# Altium schematic sheet csi-camera-ethernet.SchDoc: HDMI / CAMERA / DISPLAY / SDCARD
size A4; ApprovedBy: Yves Chevallier; CheckedBy: Yves Chevallier; Author: Yves Chevallier; CompanyName: EPFL; DrawnBy: Yves Chevallier; Engineer: Yves Chevallier; Organization: EPFL; Address1: EPFL; Address2: CH1015 Lausanne; Address3: +41(0)21 693 36 98; Address4: +41(0)21 693 26 00; DocumentNumber: ABC.00.0000.000.0; Revision: v1.0; SheetNumber: 0; SheetTotal: 0; DrawnByDate: 2000-01-01; ExecutionWarrantDate: 2000-01-01; ExecutionWarrant: Yves Chevallier; Context: Confidential; PageSetup: Record=PageOptions|CenterHorizontal=True|CenterVertical=False|PrintScale=0.97|XCorrection=1.00|YCorrection=1.00|PrintKind=0|BorderSize=5000000|LeftOffset=0|BottomOffset=0|Orientation=2|PaperLength=1000|PaperWidth=1000|Scale=100|PaperSource=262|PrintQuality=600|MediaType=1|DitherType=10|PaperKind=A4|PrintScaleMode=1; EngineerDate: 2000-01-01; CheckedByDate: 2000-01-01; SVN: OUI; ProjectName: PRJ
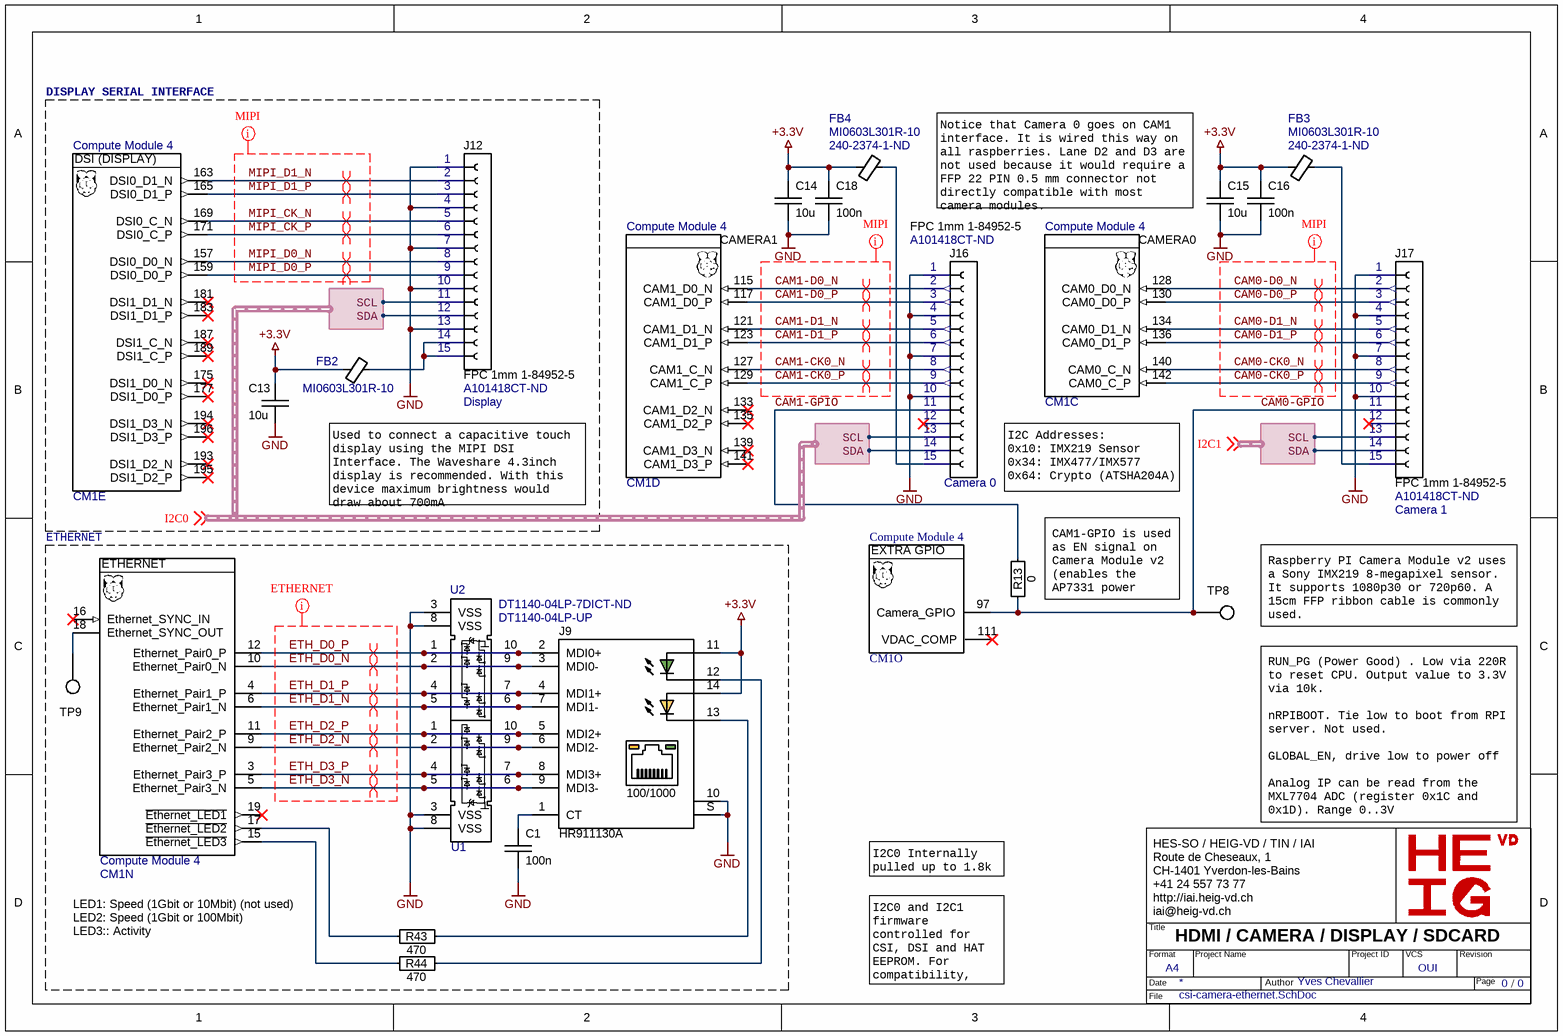
[diagram p0: csi-camera-ethernet.SchDoc]

## Parts
(Parts that share a designator on the sheet are numbered #1, #2 ... from top to bottom, then left to right.)
C1  100n  [SM/C0603]
C13  10u  [SM/C0805]
C14  10u  [SM/C0805]
C15  10u  [SM/C0805]
C16  100n  [SM/C0603]
C18  100n  [SM/C0603]
CM1#1  Compute Module 4  [CM4-RASPBERRY-PI4]  (parts C,D,E,N of 16)
CM1#2  Compute Module 4  [CM4-RASPBERRY-PI4]  (part O of 15)
FB2  MI0603L301R-10  [SM/L0603]
FB3  MI0603L301R-10  Supplier Part Number 1: 240-2374-1-ND  [SM/L0603]
FB4  MI0603L301R-10  Supplier Part Number 1: 240-2374-1-ND  [SM/L0603]
J9  HR911130A  [CONN/ETHERNET/HR911130A]
J12  FPC 1mm 1-84952-5  Supplier Part Number 1: A101418CT-ND  Function: Display  [CONN15/FPC/TE/1-84952-5]
J16  FPC 1mm 1-84952-5  Supplier Part Number 1: A101418CT-ND  Function: Camera 0  [CONN15/FPC/TE/1-84952-5]
J17  FPC 1mm 1-84952-5  Supplier Part Number 1: A101418CT-ND  Function: Camera 1  [CONN15/FPC/TE/1-84952-5]
R13  0  [SM/R0805]
R43  470  [SM/R0603]
R44  470  [SM/R0603]
TP8  TP  [TP/SMALL]  (value not drawn)  (no BOM)
TP9  SYNC_OUT  [TP/SMALL]  (value not drawn)  (no BOM)
U1  DT1140-04LP-DN  [SOT1165-1]  (value not drawn)
U2  DT1140-04LP-UP  Supplier Part Number 1: DT1140-04LP-7DICT-ND  [SOT1165-1]

## Blocks framed on the sheet
DISPLAY SERIAL INTERFACE: C13 CM1#1 FB2 J12
ETHERNET: C1 CM1#1 J9 R43 R44 TP9 U1 U2

## Harnesses
I2C: SDA, SCL

## Nets
+3.3V: C13.1 C14.1 C15.1 C16.1 C18.1 FB2.1 FB3.1 FB4.1 J9.11(LED_GREEN1) J9.14(LED_YELLOW1)
GND: C1.2 C13.2 C14.2 C15.2 C16.2 C18.2 J9.10(CHS_GND) J9.S J12.1 J12.4 J12.7 J12.10 J12.13 J16.1 J16.4 J16.7 J16.10 J17.1 J17.4 J17.7 J17.10 U1.3(VSS) U1.8(VSS) U2.3(VSS) U2.8(VSS)
CAM0-CK0_N: CM1#1.140(CAM0_C_N) J17.8
CAM0-CK0_P: CM1#1.142(CAM0_C_P) J17.9
CAM0-D0_N: CM1#1.128(CAM0_D0_N) J17.2
CAM0-D0_P: CM1#1.130(CAM0_D0_P) J17.3
CAM0-D1_N: CM1#1.134(CAM0_D1_N) J17.5
CAM0-D1_P: CM1#1.136(CAM0_D1_P) J17.6
CAM0-GPIO: CM1#2.97(Camera_GPIO) J17.11 R13.2 TP8.1
CAM1-CK0_N: CM1#1.127(CAM1_C_N) J16.8
CAM1-CK0_P: CM1#1.129(CAM1_C_P) J16.9
CAM1-D0_N: CM1#1.115(CAM1_D0_N) J16.2
CAM1-D0_P: CM1#1.117(CAM1_D0_P) J16.3
CAM1-D1_N: CM1#1.121(CAM1_D1_N) J16.5
CAM1-D1_P: CM1#1.123(CAM1_D1_P) J16.6
CAM1-GPIO: J16.11 R13.1
ETH_D0_N: CM1#1.10(Ethernet_Pair0_N) J9.3(MDI0-) U2.2 U2.9
ETH_D0_P: CM1#1.12(Ethernet_Pair0_P) J9.2(MDI0+) U2.1 U2.10
ETH_D1_N: CM1#1.6(Ethernet_Pair1_N) J9.7(MDI1-) U2.5 U2.6
ETH_D1_P: CM1#1.4(Ethernet_Pair1_P) J9.4(MDI1+) U2.4 U2.7
ETH_D2_N: CM1#1.9(Ethernet_Pair2_N) J9.6(MDI2-) U1.2 U1.9
ETH_D2_P: CM1#1.11(Ethernet_Pair2_P) J9.5(MDI2+) U1.1 U1.10
ETH_D3_N: CM1#1.5(Ethernet_Pair3_N) J9.9(MDI3-) U1.5 U1.6
ETH_D3_P: CM1#1.3(Ethernet_Pair3_P) J9.8(MDI3+) U1.4 U1.7
MIPI_CK_N: CM1#1.169(DSI0_C_N) J12.5
MIPI_CK_P: CM1#1.171(DSI0_C_P) J12.6
MIPI_D0_N: CM1#1.157(DSI0_D0_N) J12.8
MIPI_D0_P: CM1#1.159(DSI0_D0_P) J12.9
MIPI_D1_N: CM1#1.163(DSI0_D1_N) J12.2
MIPI_D1_P: CM1#1.165(DSI0_D1_P) J12.3
NetC1_1: C1.1 J9.1(CT)
NetCM1#1_15: CM1#1.15(~{Ethernet_LED3}) R44.1
NetCM1#1_17: CM1#1.17(~{Ethernet_LED2}) R43.1
NetCM1#1_18: CM1#1.18(Ethernet_SYNC_OUT) TP9.1
NetFB2_2: FB2.2 J12.14 J12.15
NetFB3_2: FB3.2 J17.15
NetFB4_2: FB4.2 J16.15
NetJ9_12: J9.12(LED_GREEN2) R44.2
NetJ9_13: J9.13(LED_YELLOW2) R43.2
NetJ12_11: J12.11 J16.13 ; harness I2C.SCL
NetJ12_12: J12.12 J16.14 ; harness I2C.SDA
NetJ17_13: J17.13 ; harness I2C.SCL
NetJ17_14: J17.14 ; harness I2C.SDA

Not connected (* = marked no-connect by the designer): CM1#1 16(Ethernet_SYNC_IN)* 19(~{Ethernet_LED1})* 133(CAM1_D2_N)* 135(CAM1_D2_P)* 139(CAM1_D3_N)* 141(CAM1_D3_P)* 175(DSI1_D0_N)* 177(DSI1_D0_P)* 181(DSI1_D1_N)* 183(DSI1_D1_P)* 187(DSI1_C_N)* 189(DSI1_C_P)* 193(DSI1_D2_N)* 194(DSI1_D3_N)* 195(DSI1_D2_P)* 196(DSI1_D3_P)*; CM1#2 111(VDAC_COMP)*; J16 12*; J17 12*

## Layout directives
differential pair; differential pair class MIPI: CAM0-CK0_N, CAM0-CK0_P, CAM0-D0_N, CAM0-D0_P, CAM0-D1_N, CAM0-D1_P, CAM1-CK0_N, CAM1-CK0_P, CAM1-D0_N, CAM1-D0_P, CAM1-D1_N, CAM1-D1_P, MIPI_CK_N, MIPI_CK_P, MIPI_D0_N, MIPI_D0_P, MIPI_D1_N, MIPI_D1_P
net class MIPI; rule Routing Priority [Priority = 5]; rule Differential Pairs Routing [Pref Gap = 10.717mil    Min Gap  = 5.906mil    Max Gap  = 10.717milPref Width = 7.231mil    Min Width  = 5.906mil    Max Width  = 7.231mil]: CAM0-CK0_N, CAM0-CK0_P, CAM0-D0_N, CAM0-D0_P, CAM0-D1_N, CAM0-D1_P, CAM1-CK0_N, CAM1-CK0_P, CAM1-D0_N, CAM1-D0_P, CAM1-D1_N, CAM1-D1_P
rule Routing Priority [Priority = 5]; rule Differential Pairs Routing [Pref Gap = 0.272mm    Min Gap  = 0.15mm    Max Gap  = 0.272mmPref Width = 0.184mm    Min Width  = 0.15mm    Max Width  = 0.184mm]; net class MIPI: MIPI_CK_N, MIPI_CK_P, MIPI_D0_N, MIPI_D0_P, MIPI_D1_N, MIPI_D1_P
differential pair; differential pair class ETHERNET: ETH_D0_N, ETH_D0_P, ETH_D1_N, ETH_D1_P, ETH_D2_N, ETH_D2_P, ETH_D3_N, ETH_D3_P
net class ETH; rule Differential Pairs Routing [Pref Gap = 10.717mil    Min Gap  = 5.906mil    Max Gap  = 10.717milPref Width = 7.231mil    Min Width  = 5.906mil    Max Width  = 7.231mil]; rule Matched Net Lengths [Tolerance = 3mil]: ETH_D0_N, ETH_D0_P, ETH_D1_N, ETH_D1_P, ETH_D2_N, ETH_D2_P, ETH_D3_N, ETH_D3_P

## Notes on the sheet
- (near C15) Notice that Camera 0 goes on CAM1 interface. It is wired this way on all raspberries. Lane D2 and D3 are not used because it would require a FFP 22 PIN 0.5 mm connector not directly compatible with most camera modules.
- Used to connect a capacitive touch display using the MIPI DSI Interface. The Waveshare 4.3inch display is recommended. With this device maximum brightness would draw about 700mA
- I2C Addresses:
  0x10: IMX219 Sensor
  0x34: IMX477/IMX577
  0x64: Crypto (ATSHA204A)
- CAM1-GPIO is used as EN signal on Camera Module v2 (enables the AP7331 power supply).
- (near TP8) Raspberry PI Camera Module v2 uses a Sony IMX219 8-megapixel sensor. It supports 1080p30 or 720p60. A 15cm FFP ribbon cable is commonly used.
- (near TP8) RUN_PG (Power Good) . Low via 220R to reset CPU. Output value to 3.3V via 10k.
  nRPIBOOT. Tie low to boot from RPI server. Not used.
  GLOBAL_EN, drive low to power off
  Analog IP can be read from the MXL7704 ADC (register 0x1C and 0x1D). Range 0..3V
- I2C0 Internally pulled up to 1.8k
- LED1: Speed (1Gbit or 10Mbit) (not used)
  LED2: Speed (1Gbit or 100Mbit)
  LED3:: Activity
- I2C0 and I2C1 firmware controlled for CSI, DSI and HAT EEPROM. For compatibility, they are not user used.
- Labels drawn without touching a wire or pin: I2C0, I2C1
- HES-SO / HEIG-VD / TIN / IAI
  Route de Cheseaux, 1
  CH-1401 Yverdon-les-Bains
  +41 24 557 73 77
  http://iai.heig-vd.ch
  iai@heig-vd.ch
- Title
- Format
- Date
- A4
- Project Name
- Author
- Project ID
- VCS
- Revision
- Page
- /
- File
- (in symbol CM4, part C) CAMERA0
- (in symbol CM4, part D) CAMERA1
- (in symbol CM4, part E) DSI (DISPLAY)
- (in symbol CM4, part N) ETHERNET
- (in symbol CM4, part O) EXTRA GPIO
- (in symbol CONN/ETHERNET/HR911130A) 100/1000

## Library data of the parts
C1 C16 C18 = C: Chip Capacitor; Voltage: 16V; Dielectric: X7R; Supplier 2 Part Number: 1292-1393-1-ND; Supplier 2: Digi-Key
C13-C15 = C: CAP CER 10UF 10V X5R 0805; Supplier 1: Digi-Key; Supplier Part Number 1: 1276-2402-1-ND
CM1#1 CM1#2 = CM4: Raspberry Pi Compute Module 4 by Amornthep Phunsin
FB2-FB4 = FB0603: Supplier 1: Digi-Key
  FB2: Supplier Part Number 1: 240-2374-1-ND
J9 = CONN/ETHERNET/HR911130A
J12 J16 J17 = CONN 15 FEMALE: CONN FPC BOTTOM 15POS 1.00MM R/A; Supplier 1: Digi-Key
R13 R43 R44 = R: Chip Resistor SMD
TP8 TP9 = TP: Test Point
U1 = DT1140-04LP-DN: TVS DIODE 5.5VWM 10VC U-DFN2510; Supplier 1: Digi-Key; Supplier Part Number 1: DT1140-04LP-7DICT-ND
U2 = DT1140-04LP-UP: TVS DIODE 5.5VWM 10VC U-DFN2510; Supplier 1: Digi-Key